# EasyEDA Pro project hardware.eprj, board PCB29
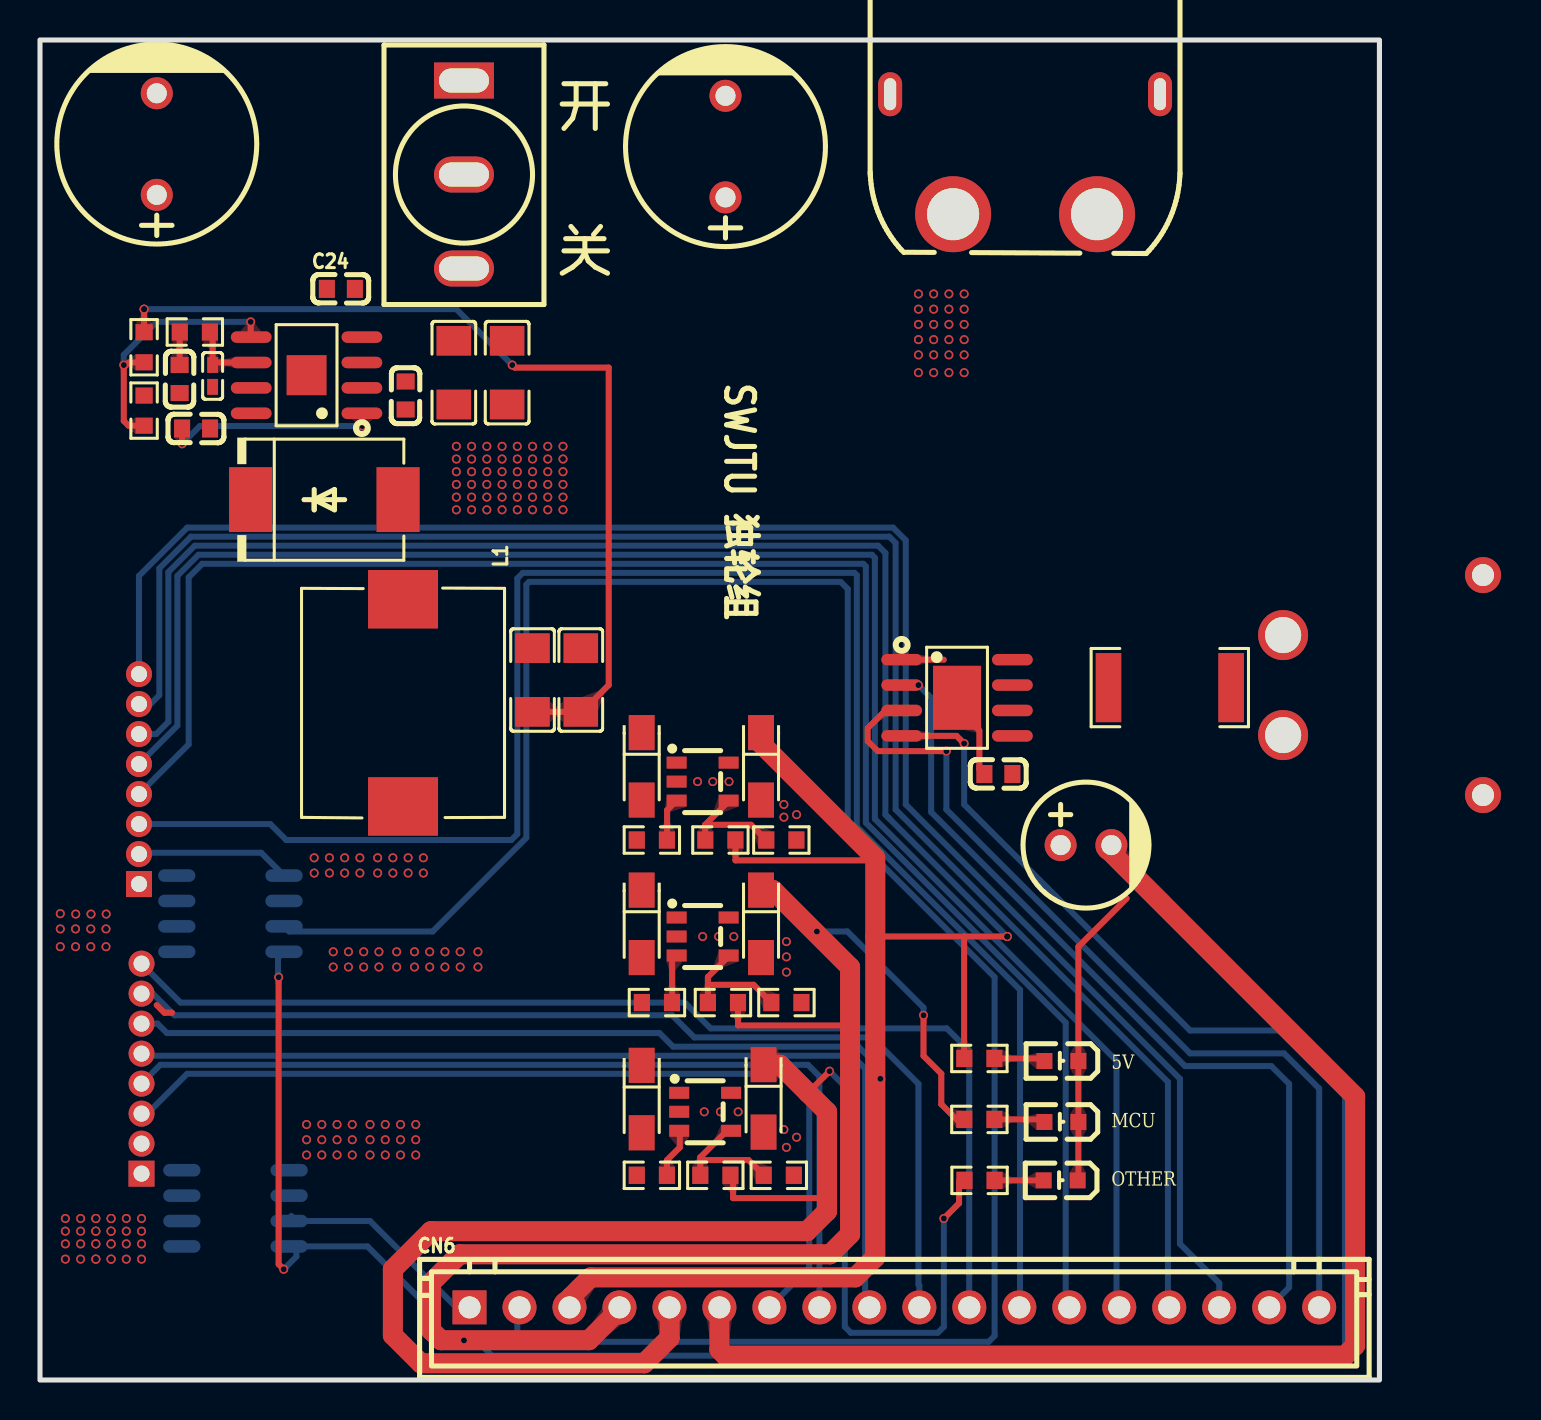
[diagram p12: board, top side]
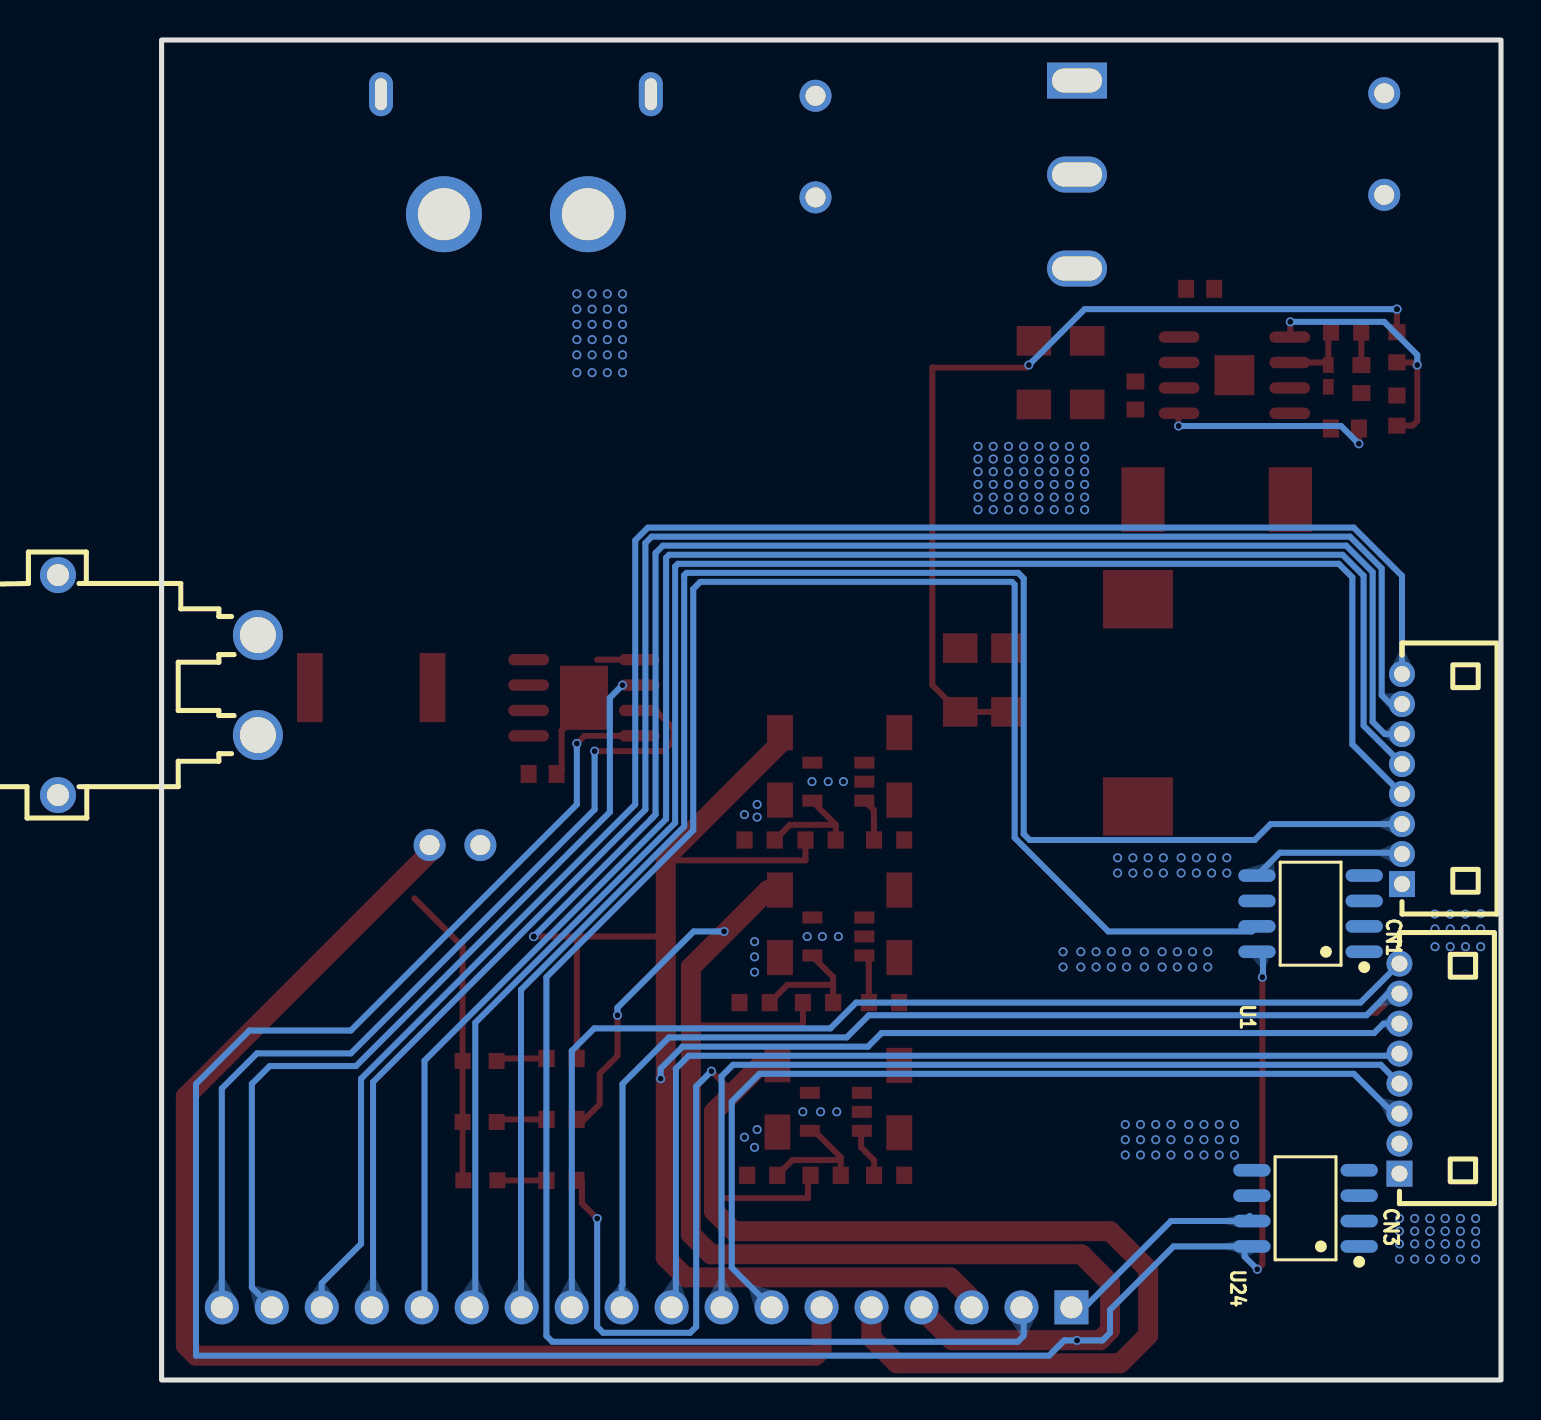
[diagram p13: board, bottom side, seen from below]

Outline 67 x 67 mm; copper layers: Top Layer, Bottom Layer. Coordinates in mm from the lower left corner of the outline.
Outline path: rectangle 0,67 67,0
Stack: Top Layer 0.035mm / Dielectric1 1.51mm FR4 er 4.5 / Bottom Layer 0.035mm

## Design rules (mm)
spacing safeClearance (default): track to track 0.152, other pairs 0.152 to 0.3
track width trackWidth (default): min 0.127, default 0.254, max 2.54
differential pair differentialPair (default): width min 0.127, default 0.254, max 2.54; gap min 0.152, default 0.152
via viaSize (default): diameter min 0.25, default 0.45, max 10; hole min 0.15, default 0.3, max 6

## Placement (name value [footprint] x y rotation side)
C1  100nF  [C0603]  47.94 30.3 0 top
C7  220uF  [CAP-TH_BD10.0-P5.00-D1.0-FD]  34.29 61.67 90 top
C21  10uF  [C1206]  23.37 50.37 90 top
C23  10uF  [C1206]  20.7 50.37 90 top
C24  8.2nF  [C0603]  15.05 54.56 0 top
C25  10pF  [C0402]  8.64 50.2 90 top
C26  1nF  [C0603]  6.98 50.05 90 top
C27  100nF  [C0603]  7.81 47.57 0 top
C28  47uF  [C1206]  27.05 35 270 top
C29  47uF  [C1206]  24.64 35 270 top
C30  1uF  [CAP-SMD_L3.2-W1.6-RD]  36.07 30.68 270 top
C31  1uF  [CAP-SMD_L3.2-W1.6-RD]  30.1 30.68 270 top
C32  1uF  [CAP-SMD_L3.2-W1.6-RD]  36.19 14.08 270 top
C33  1uF  [CAP-SMD_L3.2-W1.6-RD]  30.1 14.05 270 top
C34  1uF  [CAP-SMD_L3.2-W1.6-RD]  36.07 22.81 270 top
C35  1uF  [CAP-SMD_L3.2-W1.6-RD]  30.1 22.81 270 top
C36  220uF  [CAP-TH_BD10.0-P5.00-D1.0-FD]  5.84 61.8 90 top
C37  10nF  [C0603]  18.29 49.22 90 top
C38  47uF  [CAP-TH_BD6.3-P2.50-D1.0-FD]  52.32 26.75 0 top
CN1  HC-ZH1.5-8AW  [CONN-TH_8P-P1.50_HCTL_HC-ZH1.5-8AW]  4.95 30.05 90 bottom
CN3  HC-ZH1.5-8AW  [CONN-TH_8P-P1.50_HCTL_HC-ZH1.5-8AW]  5.08 15.57 90 bottom
CN4  XT60PW-M  [CONN-TH_XT60PW-M]  49.28 61.29 270 top
CN5  XT30PW-M  [CONN-TH_XT30PW-M]  67.18 34.75 270 bottom
CN6  HX25003-18AN  [CONN-TH_HX25003-18AN]  42.74 3.63 0 top
D1  SS54C  [SMC_L6.9-W5.9-LS7.9-R-RD]  14.22 44.02 0 top
L1  10uH  [IND-SMD_L11.5-W10.0_SMMS1040]  18.16 33.86 270 top
LED2  19-217/GHC-YR1S2/3T  [LED0603-R-RD]  51.09 12.9 180 top
LED3  19-217/GHC-YR1S2/3T  [LED0603-R-RD]  51.09 15.95 180 top
LED4  19-217/GHC-YR1S2/3T  [LED0603-R-RD]  51.05 9.98 180 top
R2  3.83kΩ  [R0603]  34.04 27 0 top
R7  10kΩ  [R0603]  30.61 10.23 0 top
R17  0603WAF1201T5E  [R0603]  36.96 10.23 180 top
R19  10kΩ  [R0603]  30.86 18.87 0 top
R20  0603WAF1201T5E  [R0603]  37.34 18.87 180 top
R22  2.7kΩ  [R0603]  47 9.98 180 top
R23  2.7kΩ  [R0603]  46.99 13.03 180 top
R24  10kΩ  [R0603]  30.61 27 0 top
R25  2.1kΩ  [R0603]  34.16 18.87 0 top
R26  2.1kΩ  [R0603]  33.78 10.23 0 top
R31  0603WAF1201T5E  [R0603]  37.08 27 180 top
R33  0603WAF6812T5E  [R0603]  7.75 52.4 0 top
R34  10.2kΩ  [R0603]  5.21 51.64 90 top
R35  1.74kΩ  [R0603]  5.21 48.47 270 top
R36  0603WAF4701T5E  [R0603]  46.99 16.08 180 top
R37  200mΩ  [R2512]  56.51 34.62 0 top
SW2  MT-0-103-A101-M200-RS+PJ  [SW-TH_MT-0-103-A101-M200-RS]  21.21 60.27 270 top
U1  CC6902SO-5A  [SOP-8_L4.9-W3.9-P1.27-LS6.0-BL]  9.53 23.32 90 bottom
U8  TPS54331DDAR  [SOIC-8_L5.0-W4.0-P1.27-LS6.0-BL-EP2.0]  13.33 50.24 90 top
U9  RT9043GB  [SOT-23-5_L3.0-W1.7-P0.95-LS2.8-BR]  33.15 29.92 180 top
U10  RT9043GB  [SOT-23-5_L3.0-W1.7-P0.95-LS2.8-BR]  33.27 13.41 180 top
U11  RT9043GB  [SOT-23-5_L3.0-W1.7-P0.95-LS2.8-BR]  33.15 22.17 180 top
U12  DRV8870DDAR  [HSOP-8_L5.0-W4.0-P1.27-LS6.2-BL-EP]  45.87 34.11 270 top
U24  CC6902SO-5A  [SOP-8_L4.9-W3.9-P1.27-LS6.0-BL]  9.78 8.58 90 bottom

## Footprints (pads in the part's own frame, mm; a bottom-side part is the same pattern mirrored in y, then rotated)
C0402
  rect 0.79x0.54 smd: 1(-0.545,0) 2(0.545,0)
C0603
  rect 0.8x0.9 smd: 1(-0.7,0) 2(0.7,0)
C1206
  rect 1.485x1.728 smd: 1(-1.593,0) 2(1.593,0)
CAP-SMD_L3.2-W1.6-RD
  rect 1.758x1.296 smd: 1(-1.687,0) 2(1.687,0)
CAP-TH_BD6.3-P2.50-D1.0-FD
  round 1.6 hole 1: 1(-1.27,0) 2(1.27,0)
CAP-TH_BD10.0-P5.00-D1.0-FD
  round 1.6 hole 1: 1(-2.54,0) 2(2.54,0)
CONN-TH_8P-P1.50_HCTL_HC-ZH1.5-8AW
  rect 1.3x1.3 hole 0.8: 1(-5.25,0)
  round 1.3 hole 0.8: 2(-3.75,0) 3(-2.25,0) 4(-0.75,0) 5(0.75,0) 6(2.25,0) 7(3.75,0) 8(5.25,0)
CONN-TH_HX25003-18AN
  rect 1.7x1.7 hole 1.1: 1(-21.25,0)
  round 1.7 hole 1.1: 2(-18.75,0) 3(-16.251,0) 4(-13.749,0) 5(-11.249,0) 6(-8.751,0) 7(-6.251,0) 8(-3.749,0) 9(-1.25,0) 10(1.25,0) 11(3.749,0) 12(6.251,0) 13(8.751,0) 14(11.249,0) 15(13.749,0) 16(16.251,0) 17(18.75,0) 18(21.25,0)
CONN-TH_XT30PW-M
  round 2.5 hole 1.8: 1(-2.5,5) 2(2.5,5)
  round 1.8 hole 1.1: 3(5.5,-5) 4(-5.5,-5)
CONN-TH_XT60PW-M
  round 3.8 hole 2.6: 1(3,-3.6) 2(3,3.6)
  oval 2.2x1.2 hole 1.6x0.6: 3(-3,6.75) 4(-3,-6.75)
HSOP-8_L5.0-W4.0-P1.27-LS6.2-BL-EP
  oval 0.574x2.037 smd: 1(-1.905,-2.768) 2(-0.635,-2.768) 3(0.635,-2.768) 4(1.905,-2.768) 5(1.905,2.768) 6(0.635,2.768) 7(-0.635,2.768) 8(-1.905,2.768)
  rect 3.2x2.401 smd: 9(0,0)
IND-SMD_L11.5-W10.0_SMMS1040
  rect 2.924x3.5 smd: 1(-5.181,0) 2(5.181,0)
LED0603-R-RD
  rect 0.8x0.8 smd: 1(0.851,0) 2(-0.851,0)
R0603
  rect 0.806x0.864 smd: 1(-0.753,0) 2(0.753,0)
R2512
  rect 1.282x3.456 smd: 1(-3.067,0) 2(3.067,0)
SMC_L6.9-W5.9-LS7.9-R-RD
  rect 2.158x3.24 smd: 1(3.687,0) 2(-3.687,0)
SOIC-8_L5.0-W4.0-P1.27-LS6.0-BL-EP2.0
  oval 0.574x2.037 smd: 1(-1.905,-2.768) 2(-0.635,-2.768) 3(0.635,-2.768) 4(1.905,-2.768) 5(1.905,2.768) 6(0.635,2.768) 7(-0.635,2.768) 8(-1.905,2.768)
  rect 1.999x1.999 smd: 9(0,0)
SOP-8_L4.9-W3.9-P1.27-LS6.0-BL
  oval 0.63x1.865 smd: 1(-1.905,-2.683) 2(-0.635,-2.683) 3(0.635,-2.683) 4(1.905,-2.683) 5(1.905,2.683) 6(0.635,2.683) 7(-0.635,2.683) 8(-1.905,2.683)
SOT-23-5_L3.0-W1.7-P0.95-LS2.8-BR
  rect 1x0.6 smd: 1(1.3,-0.95) 2(1.3,0) 3(1.3,0.95) 4(-1.3,0.95) 5(-1.3,-0.95)
SW-TH_MT-0-103-A101-M200-RS
  rect 1.8x3 hole 1.2x2.5: 1(-4.7,0)
  oval 1.8x3 hole 1.2x2.5: 2(0,0) 3(4.7,0)

## Nets
As in the schematic.

Pads without a net: CN4 3; CN5 3 4; U1 6; U8 3; U24 6

## Via types
v1: diameter 0.45, hole 0.3, Top Layer to Bottom Layer, 219 vias

## Routing (per net, layer and track width the routed paths; a pad name or vN(x,y) marks a point on that pad's centre or on a via; arc(x,y) is an arc through that point)
3.3V_LDO_CAM&MCU: length 85.2
  Top Layer w0.3: 38.42,14.36 v1(39.5,15.44) ; 39.37,9.22 39.24,9.09 34.67,9.09 34.67,10.1 R26.2 ; 45.97,9.98 45.97,8.84 v1(45.21,8.08)
  Top Layer w1: 36.19,15.77 37.01,15.77 39.37,13.41 39.37,8.44 38.37,7.44 19.56,7.44 17.65,5.54 17.65,2.23 19.05,0.84 30.23,0.84 31.5,2.11 31.5,3.63
  Bottom Layer w0.3: v1(45.21,8.08) 45.21,2.66 44.91,2.36 40.56,2.36 40.26,2.66 40.26,14.68 v1(39.5,15.44)
3.3V_LDO_OTHER: length 192.3
  Top Layer w0.3: v1(11.94,20.14) 11.94,5.79 v1(12.19,5.54) ; v1(46.23,31.83) 45.85,32.21 U12.4 ; 40.52,17.73 34.93,17.73 34.92,17.74 R25.2 ; v1(44.2,18.24) 44.2,16.2 45.09,15.31 45.09,13.79 45.97,12.9
  Top Layer w1: CN6.4 28.96,3.6 28.96,3.49 27.46,1.99 20.06,1.99 19.56,2.49 19.56,4.86 20.99,6.29 39.52,6.29 40.52,7.29 40.52,20.64 36.67,24.49 C34.1
  Bottom Layer w0.3: v1(11.94,20.14) 11.91,20.17 11.91,21.11 U1.8 ; 12.83,6.68 12.83,6.17 v1(12.19,5.54) ; 12.83,6.68 U24.8 ; 12.83,6.68 16.38,6.68 19.56,3.5 19.56,2.36 19.94,1.98 v1(21.21,1.98) 21.84,1.98 22.61,1.22 65.28,1.22 65.28,14.81 62.61,17.47 57.53,17.47 46.23,28.78 v1(46.23,31.83) ; v1(38.86,22.43) 40.39,22.43 44.2,18.62 v1(44.2,18.24)
5.5V_DCDC: length 45.8
  Top Layer w0.3: C29.2 26.87,33.41 26.92,33.35 ; 27.05,33.35 28.45,34.75 28.45,50.62 23.75,50.62 v1(23.62,50.75) ; R34.2 v1(5.21,53.54)
  Bottom Layer w0.3: v1(5.21,53.54) 20.83,53.54 v1(23.62,50.75)
5V_LDO: length 172.3
  Top Layer w0.3: R2.2 34.79,25.99 34.8,25.98 41.66,25.98 41.78,26.11 ; 46.23,22.17 41.78,22.17 ; 46.23,22.17 46.23,16.2 ; 46.23,22.17 v1(48.39,22.17) ; v1(42.04,15.06) 41.78,15.06
  Top Layer w1: C30.1 36.07,31.83 41.78,26.11 41.78,6.13 40.78,5.13 27.54,5.13 26.54,4.13 26.54,3.5
  Bottom Layer w0.3: v1(42.04,15.06) 42.04,15.57 40.94,16.67 31.67,16.67 30.99,17.35 6.35,17.35 5.88,17.82 CN3.6 ; CN1.6 5.81,32.3 6.42,32.91 6.42,40.4 7.74,41.72 41.93,41.72 42.29,41.35 42.29,28.27 42.5,28.06 42.4,28.15 48.38,22.17
GND: length 92.2
  Top Layer w0.3: 54.36,24.08 51.94,21.67 LED3.2 51.94,13.03 51.82,12.9 ; U12.1 45.21,36.02 ; LED4.2 51.94,10.02 LED2.2 ; C1.1 46.99,30.55 46.99,32.46 46.23,33.22
  Top Layer w1: 53.47,26.49 65.79,14.17 65.79,1.73 65.28,1.22 34.29,1.22 33.99,1.52 CN6.6
  Bottom Layer w0.3: 5.21,26.36 11.06,26.36 U1.5
  vias: v1(13.33,12.78) v1(13.33,12.01) v1(13.33,11.25) v1(13.72,26.11) v1(13.72,25.35) v1(14.1,12.78) v1(14.1,12.01) v1(14.1,11.25) v1(14.48,26.11) v1(14.48,25.35) v1(14.67,21.41) v1(14.67,20.65) v1(14.86,12.78) v1(14.86,12.01) v1(14.86,11.25) v1(15.24,26.11) v1(15.24,25.35) v1(15.43,21.41) v1(15.43,20.65) v1(15.62,12.78) v1(15.62,12.01) v1(15.62,11.25) v1(16,26.11) v1(16,25.35) v1(16.19,21.41) v1(16.19,20.65) v1(16.51,12.78) v1(16.51,12.01) v1(16.51,11.25) v1(16.89,26.11) v1(16.89,25.35) v1(16.95,21.41) v1(16.95,20.65) v1(17.27,12.78) v1(17.27,12.01) v1(17.27,11.25) v1(17.65,26.11) v1(17.65,25.35) v1(17.84,21.41) v1(17.84,20.65) v1(18.03,12.78) v1(18.03,12.01) v1(18.03,11.25) v1(18.41,26.11) v1(18.41,25.35) v1(18.73,21.41) v1(18.73,20.65) v1(18.8,12.78) v1(18.8,12.01) v1(18.8,11.25) v1(19.18,26.11) v1(19.18,25.35) v1(19.49,21.41) v1(19.49,20.65) v1(20.26,21.41) v1(20.26,20.65) v1(20.83,46.68) v1(20.83,46.05) v1(20.83,45.41) v1(20.83,44.78) v1(20.83,44.14) v1(20.83,43.51) v1(21.02,21.41) v1(21.02,20.65) v1(21.59,46.68) v1(21.59,46.05) v1(21.59,45.41) v1(21.59,44.78) v1(21.59,44.14) v1(21.59,43.51) v1(21.91,21.41) v1(21.91,20.65) v1(22.35,46.68) v1(22.35,46.05) v1(22.35,45.41) v1(22.35,44.78) v1(22.35,44.14) v1(22.35,43.51) v1(23.11,46.68) v1(23.11,46.05) v1(23.11,45.41) v1(23.11,44.78) v1(23.11,44.14) v1(23.11,43.51) v1(23.88,46.68) v1(23.88,46.05) v1(23.88,45.41) v1(23.88,44.78) v1(23.88,44.14) v1(23.88,43.51) v1(24.64,46.68) v1(24.64,46.05) v1(24.64,45.41) v1(24.64,44.78) v1(24.64,44.14) v1(24.64,43.51) v1(25.4,46.68) v1(25.4,46.05) v1(25.4,45.41) v1(25.4,44.78) v1(25.4,44.14) v1(25.4,43.51) v1(26.16,46.68) v1(26.16,46.05) v1(26.16,45.41) v1(26.16,44.78) v1(26.16,44.14) v1(26.16,43.51) v1(32.89,29.92) v1(33.15,22.17) v1(33.23,13.41) v1(33.66,29.92) v1(33.95,22.17) v1(34.04,13.41) v1(34.47,29.92) v1(34.71,22.17) v1(34.92,13.41) v1(37.21,28.78) v1(37.21,28.14) v1(37.21,12.52) v1(37.34,21.92) v1(37.34,21.16) v1(37.34,20.39) v1(37.34,11.63) v1(37.85,28.27) v1(37.85,12.14) v1(43.94,54.3) v1(43.94,53.54) v1(43.94,52.78) v1(43.94,52.02) v1(43.94,51.26) v1(43.94,50.37) v1(44.7,54.3) v1(44.7,53.54) v1(44.7,52.78) v1(44.7,52.02) v1(44.7,51.26) v1(44.7,50.37) v1(45.47,54.3) v1(45.47,53.54) v1(45.47,52.78) v1(45.47,52.02) v1(45.47,51.26) v1(45.47,50.37) v1(46.23,54.3) v1(46.23,53.54) v1(46.23,52.78) v1(46.23,52.02) v1(46.23,51.26) v1(46.23,50.37)
VCC_BAT: length 0.9
  Top Layer w0.3: 5.84,18.75 6.22,18.36 6.6,18.36
  vias: v1(1.02,23.32) v1(1.02,22.55) v1(1.02,21.67) v1(1.27,8.08) v1(1.27,7.44) v1(1.27,6.81) v1(1.27,6.04) v1(1.79,23.3) v1(1.78,22.55) v1(1.78,21.67) v1(2.03,8.08) v1(2.03,7.44) v1(2.03,6.81) v1(2.03,6.04) v1(2.54,22.55) v1(2.54,21.67) v1(2.55,23.3) v1(2.79,8.08) v1(2.79,8.08) v1(2.79,7.44) v1(2.79,7.44) v1(2.79,6.81) v1(2.79,6.81) v1(2.79,6.04) v1(2.79,6.04) v1(3.31,23.3) v1(3.3,22.55) v1(3.3,21.67) v1(3.56,8.08) v1(3.56,8.08) v1(3.56,7.44) v1(3.56,7.44) v1(3.56,6.81) v1(3.56,6.81) v1(3.56,6.04) v1(3.56,6.04) v1(4.32,8.08) v1(4.32,7.44) v1(4.32,6.81) v1(4.32,6.04) v1(5.08,8.08) v1(5.08,7.44) v1(5.08,6.81) v1(5.08,6.04)
A_PIN_B: length 88.6
  Bottom Layer w0.3: CN6.15 56.42,3.7 56.42,14.9 42.8,28.52 42.8,41.85 42.48,42.17 7.55,42.17 5.97,40.58 5.97,34.24 5.46,33.73
A_PIN_F: length 51.9
  Bottom Layer w0.3: CN6.10 43.99,4.73 43.94,4.77 43.94,14.81 41.62,17.13 32.73,17.13 31.62,18.24 6.73,18.24 5.65,19.32 v1(5.08,19.32)
B_PIN_B: length 89.4
  Bottom Layer w0.3: CN6.16 58.99,4.84 57.02,6.81 57.02,15.06 43.31,28.78 43.31,41.98 42.67,42.62 7.37,42.62 4.95,40.21 v1(4.95,35.3)
B_PIN_F: length 56
  Bottom Layer w0.3: CN3.8 7.03,18.87 32.26,18.87 33.55,17.58 45.36,17.58 46.48,16.46 46.48,3.64 CN6.11
CURRENT_B_OUT: length 110.4
  Bottom Layer w0.3: CN6.2 23.99,4.15 23.88,4.27 23.88,2.21 24.18,1.91 47.45,1.91 47.75,2.21 47.75,20.14 40.41,27.49 40.41,39.55 40.05,39.91 24.46,39.91 24.33,39.77 24.33,27.11 19.64,22.43 12.46,22.43 U1.7
CURRENT_F_OUT: length 10.8
  Bottom Layer w0.3: 12.57,8.2 12.83,7.95 16.51,7.95 20.7,3.76 21.36,3.76 CN6.1
DIR_BRUSHED_MOTOR: length 41.7
  Bottom Layer w0.3: CN6.17 62.48,4.63 62.48,14.81 61.59,15.7 57.28,15.7 44.58,28.4 44.58,34.11 v1(43.94,34.75)
DIR_PIN_B: length 87.2
  Bottom Layer w0.3: v1(4.95,30.8) 6.87,32.72 6.87,40.21 7.93,41.26 41.61,41.26 41.76,41.11 41.76,28.05 53.85,15.96 53.85,4.52
DIR_PIN_F: length 48.5
  Bottom Layer w0.3: v1(5.08,16.32) 5.19,16.21 40.63,16.21 41.28,15.57 41.28,3.84 CN6.9
PWM_BRUSHED_MOTOR: length 44.3
  Top Layer w0.3: v1(45.34,31.44) 41.91,31.44 41.4,31.95 41.4,32.59 42.29,33.48
  Bottom Layer w0.3: v1(45.34,31.44) 45.34,28.52 57.53,16.33 62.23,16.33 63.99,14.57 v1(63.99,3.63)
PWM_PIN_B: length 87.3
  Bottom Layer w0.3: CN6.13 51.31,3.81 51.31,17.86 41.31,27.86 41.31,40.68 41.18,40.81 8.12,40.81 7.44,40.13 7.44,31.78 CN1.4
PWM_PIN_F: length 46.1
  Bottom Layer w0.3: CN3.4 6.02,15.76 38.42,15.76 38.99,15.19 CN6.8
STOP_PIN_B: length 89.3
  Bottom Layer w0.3: CN1.3 11.52,27.8 12.32,27 23.58,27 23.88,27.3 23.88,40.08 24.15,40.36 40.74,40.36 40.86,40.24 40.86,27.67 49.02,19.51 49.02,3.66 CN6.12
STOP_PIN_F: length 45.9
  Bottom Layer w0.3: CN6.7 38.48,5.62 38.48,13.92 37.09,15.31 7.36,15.31 5.37,13.32 CN3.3
$1N11449: length 3.4
  Top Layer w0.3: R33.2 8.64,52.26 8.64,50.88 ; U8.6 8.76,50.88
$1N11450: length 1.5
  Top Layer w0.3: C26.2 6.98,52.27
$1N11452: length 13.1
  Top Layer w0.3: v1(10.54,52.91) 10.54,52.17 U8.5 ; 5.08,50.88 4.44,50.88 4.19,50.62 4.19,47.95 4.43,47.72 5.21,47.72
  Bottom Layer w0.3: v1(10.54,52.91) 5.84,52.91 4.19,51.26 v1(4.19,50.75)
$1N11457: length 2
  Top Layer w0.3: 31.37,27.13 31.37,28.49 31.85,28.97
$1N11458: length 5.7
  Top Layer w0.3: U9.4 34.45,28.93 33.27,27.76 ; 33.27,27.76 35.57,27.76 R31.2 ; 33.27,27.76 33.27,27.13
$1N11461: length 2.5
  Top Layer w0.3: 31.88,12.39 32,12.27 32,11.63 31.36,10.99 R7.2
$1N11462: length 6.4
  Top Layer w0.3: 33.03,11.13 33.16,11 35.44,11 R17.2 ; 33.03,11.13 34.42,12.52 ; 33.03,11.13 R26.1
$1N11464: length 6.2
  Top Layer w0.3: 33.41,19.76 33.41,20.15 34.42,21.16 ; 33.41,19.76 R25.1 ; 33.41,19.76 35.7,19.76 R20.2
$1N11465: length 2.3
  Top Layer w0.3: 31.85,21.22 31.62,21 31.62,19
$1N11482: length 2.5
  Top Layer w0.3: R36.1 50.04,16.08 50.16,15.95
$1N11484: length 2.3
  Top Layer w0.3: R22.1 49.91,9.98 50.04,10.11
$1N11486: length 2.3
  Top Layer w0.3: 50.04,12.9 49.91,13.03 R23.1
$1N11493: length 10.8
  Top Layer w0.3: v1(16.13,47.7) 16.13,48.31 U8.1 ; v1(7.11,46.81) 7.11,46.81 C27.1
  Bottom Layer w0.3: v1(16.13,47.7) 8,47.7 v1(7.11,46.81)

## Copper pours and planes (outline as drawn; the poured copper is in the pictures)
3.3V_LDO_CAM&MCU on Top Layer: 34.04,14.05 34.04,16.68 34.07,16.71 36.83,16.71 36.83,14.68 36.19,14.05 34.09,14.05 34.05,14.08 34.05,14.06
3.3V_LDO_OTHER on Top Layer: 33.94,22.92 33.91,25.35 36.7,25.35 36.7,23.57 35.94,22.81 34.05,22.81
5.5V_DCDC on Top Layer: 29.84,33.22 32.38,33.22 32.38,30.56 32.36,30.54 28.21,30.54 28.19,30.56 28.19,31.57
5.5V_DCDC on Top Layer: 28.45,19.38 30.47,19.38 30.55,19.3 30.55,18.51 30.51,18.47 27.72,18.47 27.72,18.65
5.5V_DCDC on Top Layer: 28.45,25.35 32.38,25.35 32.38,22.81 28.29,22.81 28.11,22.99 28.11,25.01
5.5V_DCDC on Top Layer: 28.32,27.38 30.23,27.38 30.25,27.4 30.25,26.52 30.23,26.49 28.07,26.49 28.07,27.13
5.5V_DCDC on Top Layer: 23.72,34.07 23.72,30.78 23.11,30.17 16.38,30.17 16.38,27.13 23.5,27.13 23.62,25.98 23.62,9.73 28.57,9.73 29.21,10.36 29.21,34.14 23.79,34.14
5.5V_DCDC on Top Layer: 28.32,33.22 30.73,33.22 30.73,31.54 30.64,31.44 27.81,31.44 27.81,32.71
5.5V_DCDC on Top Layer: 28.19,16.71 32.51,16.71 32.51,14.05 27.84,14.05 27.66,14.23 27.66,16.18
5.5V_DCDC on Top Layer: 28.57,10.74 30.23,10.74 30.23,9.76 30.25,9.73 30.24,9.73 27.69,9.73 28.57,10.62
5V_LDO on Top Layer: 33.91,33.35 36.83,33.35 36.83,31.44 35.96,30.56 33.91,30.56
GND on Top Layer: 29.46,29.92 29.84,30.3 36.32,30.3 38.3,28.32 38.3,26.57 38.28,26.55 37.41,26.55 37.34,26.62 37.34,27.38 36.96,27.76 36.07,27.76 35.43,28.4 35.43,29.54 31.37,29.54 31.12,29.28 31.12,29.25 30.87,29.01 30.87,28.15 30.86,28.14 29.46,28.14
GND on Top Layer: 18.92,42.37 20.7,42.37 20.7,36.61 21.42,35.89 27.94,35.89 27.94,50.13 20.09,50.13 17.78,47.83 17.78,43.51
GND on Top Layer: 47.75,43.25 66.55,43.25 66.68,43.38 66.68,34.75 64.77,32.84 52.71,32.84 46.61,38.94 46.61,42.11
GND on Top Layer: 24.23,49.52 19.47,49.52 18.92,48.97 17.85,48.97 17.81,48.93 17.81,48.1 24.21,48.1 24.25,48.13 24.25,49.5
GND on Top Layer: 29.46,13.16 30.1,13.79 36.83,13.79 38.23,12.39 38.23,9.86 38.15,9.78 37.36,9.78 37.31,9.83 37.31,10.81 36.74,11.38 35.56,11.38 35.56,13.03 31.24,13.03 31.12,12.9 31.12,11.63 30.99,11.5 29.46,11.5
GND on Top Layer: 24.26,48.08 18.92,42.75 18.92,42.37 16.76,42.37 12.32,46.81 12.32,54.98 12.33,55 14.78,55 14.81,54.96 14.73,54.89 14.73,53.16 14.34,52.77 14.34,47.62 14.91,47.04 17.05,47.04 17.66,47.65 17.66,48.84 17.57,48.93 23.41,48.93
GND on Top Layer: 42.67,60.27 42.67,38.43 44.58,36.52 44.58,32.88 44.74,32.71 48.01,32.71 48.01,59.89 47.5,60.4 42.8,60.4
GND on Top Layer: 6.48,49.73 4.79,49.73 4.77,49.75 4.77,48.86 4.81,48.83 6.33,48.83 6.48,48.97
GND on Top Layer: 58.93,36.27 60.58,36.27 61.46,35.38 66.93,35.38 67.18,35.13 67.18,24.33 66.68,23.82 54.23,23.82 52.71,25.35 52.71,30.43 63.37,30.43 64.01,31.06 64.01,32.97 62.99,33.98 61.34,33.98 60.2,32.84 58.93,32.84
GND on Top Layer: 27.87,35.9 27.87,34.8 27.81,34.75 23.75,34.75 23.37,34.36 23.37,30.81 23.24,30.68 16.38,30.68 16.13,30.43 16.13,27.13 16.38,26.87 23.11,26.87 23.37,26.62 23.37,9.98 23.24,9.85 12.57,9.85 12.57,35.38 20.45,35.38 20.7,35.64 20.7,37.03 20.83,37.16 26.61,37.16
GND on Top Layer: 12.32,50.11 8.38,50.11 8.02,49.75 7.33,49.75 7.31,49.73 6.48,49.73 6.48,48.97 7.36,48.97 7.38,48.95 7.61,49.19 12.85,49.19 12.85,49.58
GND on Top Layer: -16.89,88.97 79.76,88.97 79.76,-3.61 -16.89,-3.61
GND on Top Layer: 29.46,22.05 29.84,22.43 29.84,22.55 37.47,22.55 38.61,21.41 38.61,18.5 38.53,18.42 37.74,18.42 37.69,18.47 37.69,19.31 37.24,19.76 36.07,20.27 35.43,20.27 35.43,21.77 31.12,21.77 30.61,21.26 30.61,20.52 29.46,21.67
GND on Bottom Layer: 50.16,66.5 0.45,66.5 0.45,43.08 44.66,43.08 50.16,48.59
GND on Bottom Layer: 6.98,27.38 11.3,27.38 12.06,26.62 20.7,26.62 20.7,24.71 11.43,24.71 11.3,24.84 11.3,25.73 10.8,26.24 6.98,26.24
GND on Bottom Layer: -25.78,70.81 93.98,70.81 93.98,-21.39 -25.78,-21.39
GND on Bottom Layer: 4.19,12.52 5.84,12.52 7.37,14.05 38.1,14.05 38.1,10.11 11.89,10.11 11.56,10.44 11.56,11.76 6.48,11.76 5.84,11.12 4.32,11.12 4.19,11.25
GND on Bottom Layer: 29.21,30.3 29.21,21.6 29.41,21.4 37.96,21.4 38.23,21.67 38.23,30.32 29.45,30.32
GND on Bottom Layer: 7.11,44.27 7.11,24.5 6.94,24.33 6.31,24.96 0.43,24.96 0.43,45.08 0.64,45.29 6.1,45.29
GND on Bottom Layer: 38.23,22.55 20.7,22.55 20.07,21.92 13.59,21.92 13.59,19.63 38.23,19.63
VCC_BAT on Top Layer: 47.5,32.59 49.66,32.59 49.66,31.83 51.05,30.43 51.44,30.43 52.2,29.67 52.2,25.86 52.07,25.73 49.02,25.73 48.13,26.62 48.13,31.19 47.5,31.83
VCC_BAT on Top Layer: 37.21,33.6 37.21,31.83 42.67,26.36 42.67,22.94 51.82,22.94 52.2,23.32 52.2,28.52 49.66,31.06 41.4,31.06 40.77,31.7 40.77,34.11 37.72,34.11
VCC_BAT on Top Layer: 12.45,66.88 0.38,66.88 0.38,55.71 18.54,55.57 18.54,60.78
VCC_BAT on Top Layer: 42.16,60.15 24.11,60.15 22.59,61.67 17.67,61.67 17.67,50.52 17.13,49.99 15.11,49.99 14.99,49.86 14.99,49.22 17.3,49.22 17.58,49.5 19.08,49.5 20.7,51.13 42.16,51.13
VCC_BAT on Top Layer: 13.84,58.05 5.08,47.64 5.08,47.38 6.35,46.11 8.38,46.11 8.64,45.86 8.64,5.35 0.51,5.35 0.38,59.32
VCC_BAT on Top Layer: 29.08,54.56 29.08,34.87 30.35,33.6 40.77,33.6 40.77,53.03 34.16,59.64
VCC_BAT on Bottom Layer: 0.51,23.7 5.33,23.7 5.84,23.19 7.93,23.19 8,23.12 8,20.96 5.91,20.96 5.59,21.28 0.47,21.28 0.47,23.66
VCC_BAT on Bottom Layer: 8.13,8.46 8.13,5.41 0.73,5.41 0.71,5.43 0.71,8.28 0.76,8.46
VCC_BAT_B on Bottom Layer: 7.87,25.6 7.87,23.32 5.97,23.32 5.46,23.82 4.29,23.82 4.19,23.92 4.19,25.6
VCC_BAT_F on Bottom Layer: 4.32,11 8.13,11 8.13,8.71 4.39,8.71 4.28,8.82 4.28,10.96
A_BRUSHED_MOTOR on Top Layer: 47.5,33.98 51.05,33.98 52.58,32.46 60.2,32.46 61.47,33.73 62.87,33.73 63.82,32.78 63.82,31.32 63.18,30.68 51.18,30.68 50.04,31.83 50.04,32.46 49.66,32.84 47.5,32.84
B_BRUSHED_MOTOR on Top Layer: 47.5,35.76 47.62,35.64 50.67,35.64 51.69,36.65 60.45,36.65 61.47,35.64 63.37,35.64 63.63,35.89 63.63,38.17 63.12,38.68 48.26,38.68 47.5,37.92
$1N4925 on Top Layer: 54.53,56.33 51.44,56.33 50.16,57.61 50.16,60.4 50.04,60.53 24.67,60.53 22.9,62.31 17.65,62.31 13.33,66.62 54.45,66.5 55.12,65.83 55.12,57.05 54.53,56.46
$1N11448 on Top Layer: 15.11,54.81 15.24,54.94 16.13,54.94 16.13,54.18 17.14,53.16 17.14,51.89 15.11,51.89
$1N11492 on Top Layer: 11.56,48.08 11.56,46.94 16.76,41.73 19.3,41.73 19.94,41.1 19.94,35.89 16.13,35.89 9.4,42.62 9.4,45.81 8.09,47.12 9.05,48.08
$1N11492 on Top Layer: 9.4,42.62 9.4,36.02 9.53,35.89 16.76,35.89 16.89,36.02 10.29,42.62
$1N11492 on Top Layer: 8.13,48.08 9.14,48.08 9.65,48.59 11.56,48.59 11.56,48.08 10.65,47.17 8.89,47.17 8.87,47.19 8.13,47.19
$1N43086 on Top Layer: 47.5,35.25 50.67,35.25 51.82,36.4 54.23,36.4 54.36,36.27 54.36,32.97 54.23,32.84 52.58,32.84 51.18,34.24 47.62,34.24 47.5,34.36

Small or netless copper shapes (teardrops, artwork), in the pictures only: 73 on Top Layer, 50 on Bottom Layer

## Text on the board
Top Silkscreen Layer: 5V | MCU | OTHER | SWJTU 独轮组 | 开 | 关
